# EasyEDA Pro project Arduino UNO DIY.eprj, board PCB3A
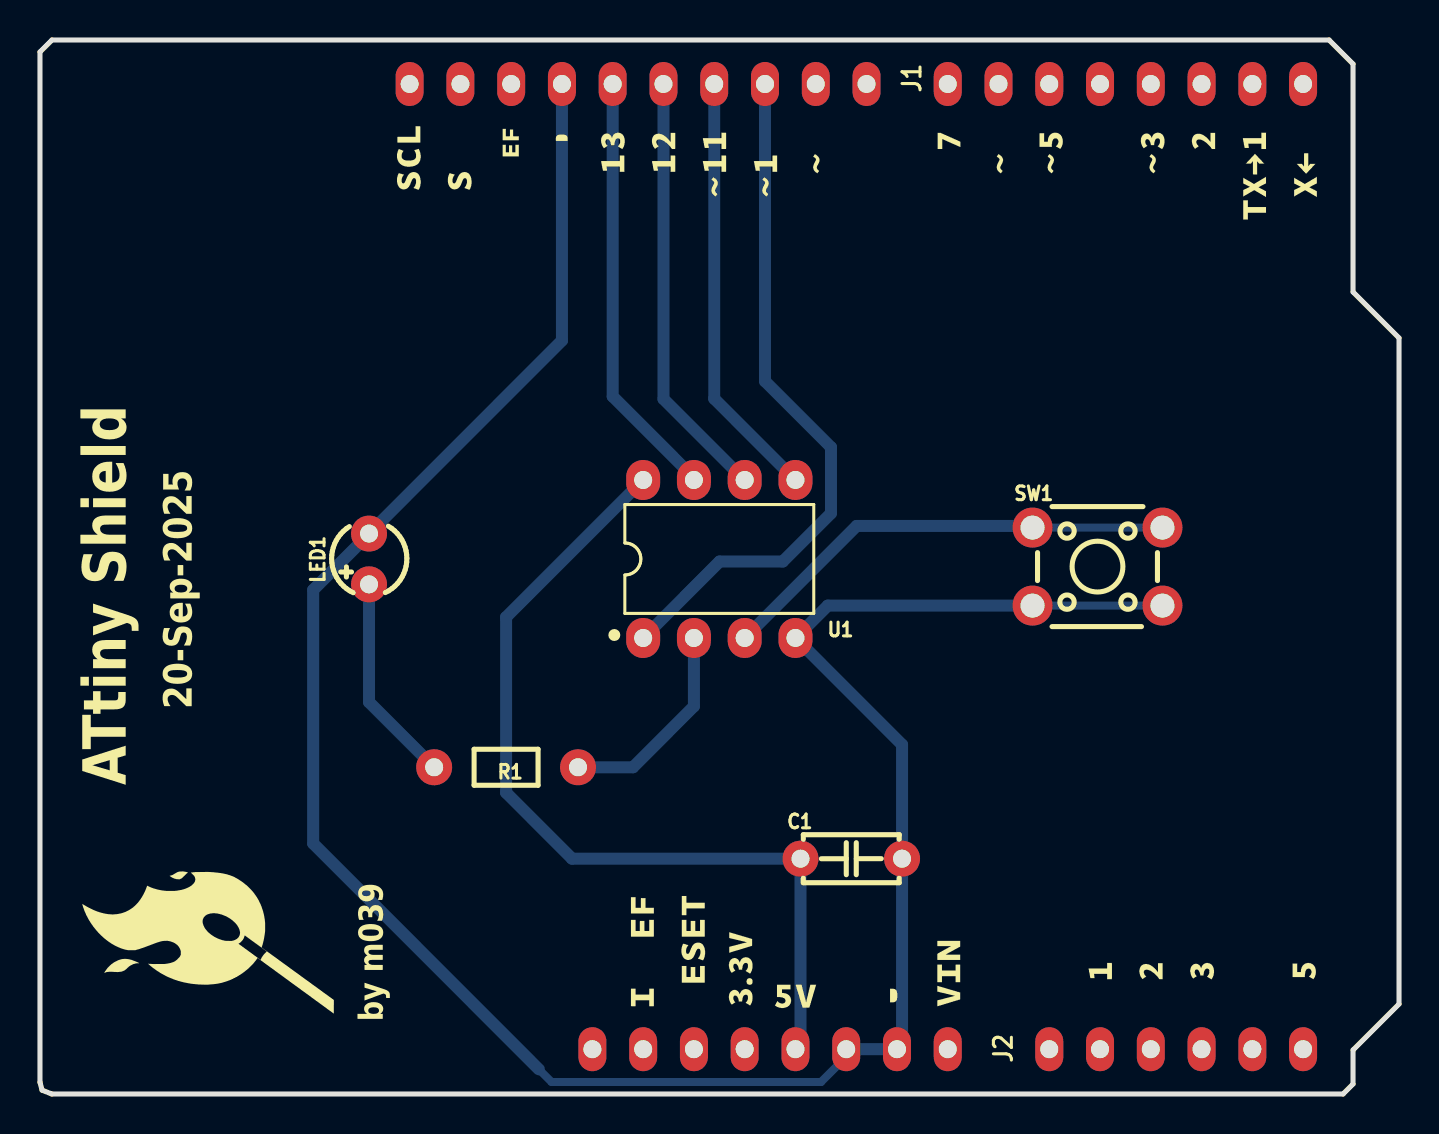
[diagram p12: board, top side]
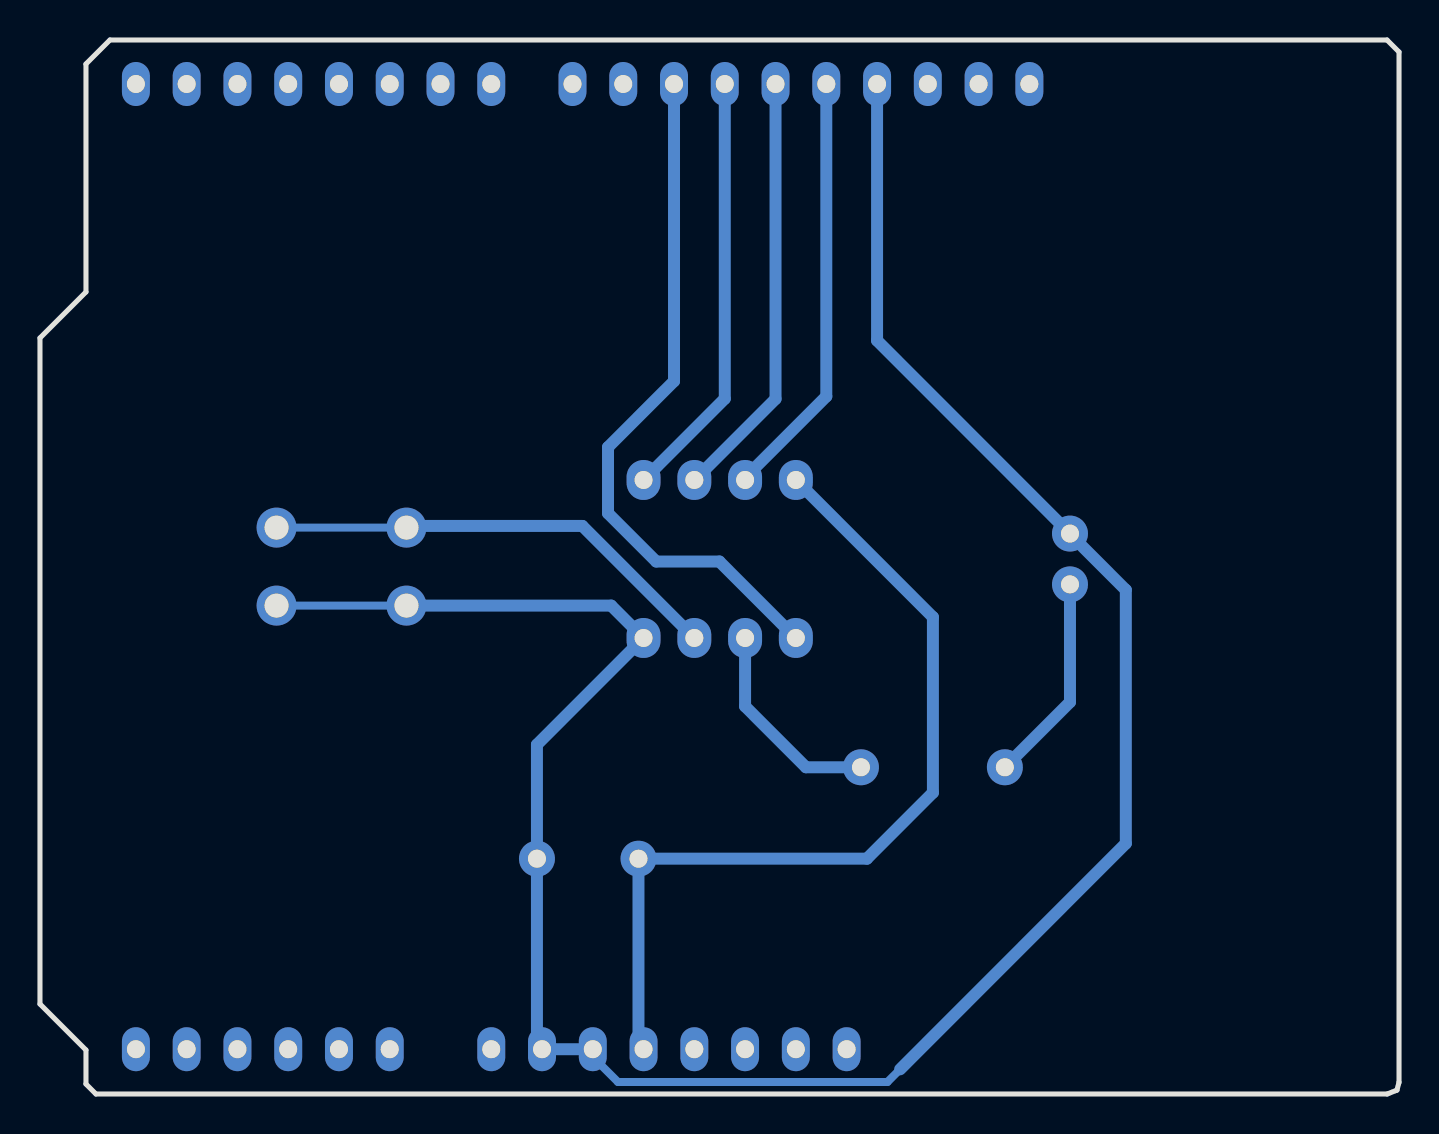
[diagram p13: board, bottom side, seen from below]

Outline 68 x 52.7 mm; copper layers: Top Layer, Bottom Layer. Coordinates in mm from the lower left corner of the outline.
Outline path: 0,52.1 0.6,52.7 64.5,52.7 65.7,51.5 65.7,40.1 68,37.8 68,4.5 65.7,2.2 65.7,0.5 65.2,0 0.59,0 0.1,0.19 0,0.59 0,52.1
Stack: Top Layer 0.035mm / Dielectric1 1.51mm FR4 er 4.5 / Bottom Layer 0.035mm

## Design rules (mm)
template: Custom Config
spacing copperThickness1oz (default): track to track 0.2, other pairs 0.152 to 0.4
spacing copperThickness2oz: track to track 0.203, other pairs 0.152 to 0.3
track width copperThickness1oz (default): min 0.127, default 0.6, max 2.54
track width copperThickness2oz: min 0.203, default 0.4, max 2.54
differential pair differentialPair (default): width min 0.127, default 0.254, max 2.54; gap min 0.152, default 0.152
via viaSize (default): diameter min 0.5, default 0.61, max 10; hole min 0.3, default 0.305, max 6.3

## Placement (name value [footprint] x y rotation side)
C1  100nF  [CAP-TH_L4.8-W2.4-P5.08-D0.6]  40.59 11.77 0 top
J1  -  [Arduino Uno Top Header]  41.36 50.5 0 top
J2  -  [Arduino Uno Bottom Header]  45.55 2.11 0 top
LED1  -  [LED-TH_BD3.0-P2.54-FD]  16.46 26.75 90 top
R1  200Ω  [RES-TH_BD1.8-L3.2-P7.20-D0.4]  23.32 16.34 180 top
SW1  -  [KEY-TH_4P-L6.0-W6.0-P3.90-LS6.5]  52.91 26.37 0 top
U1  ATTINY85-20PU  [PDIP-8_L9.3-W6.4-P2.54-LS7.9-BL-1]  33.99 26.75 0 top

## Footprints (pads in the part's own frame, mm; a bottom-side part is the same pattern mirrored in y, then rotated)
Arduino Uno Bottom Header
  oval 1.4x2.2 hole 0.9: 1(-17.907,0.127) 2(-15.367,0.127) 3(-12.827,0.127) 4(-10.287,0.127) 5(-7.747,0.127) 6(-5.207,0.127) 7(-2.667,0.127) 8(-0.127,0.127) 9(4.953,0.127) 10(7.493,0.127) 11(10.033,0.127) 12(12.573,0.127) 13(15.113,0.127) 14(17.653,0.127)
Arduino Uno Top Header
  oval 1.4x2.2 hole 0.9: 1(21.844,0) 2(19.304,0) 3(16.764,0) 4(14.224,0) 5(11.684,0) 6(9.144,0) 7(6.604,0) 8(4.064,0) 9(0,0) 10(-2.54,0) 11(-5.08,0) 12(-7.62,0) 13(-10.16,0) 14(-12.7,0) 15(-15.24,0) 16(-17.78,0) 17(-20.32,0) 18(-22.86,0)
CAP-TH_L4.8-W2.4-P5.08-D0.6
  round 1.8 hole 0.9: 1(-2.54,0) 2(2.54,0)
KEY-TH_4P-L6.0-W6.0-P3.90-LS6.5
  round 2 hole 1.2x0.9: 1(-3.25,1.95) 2(3.25,1.95) 3(-3.25,-1.95) 4(3.25,-1.95)
LED-TH_BD3.0-P2.54-FD
  round 1.8 hole 0.9: 1(-1.27,0) 2(1.27,0)
PDIP-8_L9.3-W6.4-P2.54-LS7.9-BL-1
  oval 1.7x2 hole 0.9: 1(-3.81,-3.95) 2(-1.27,-3.95) 3(1.27,-3.95) 4(3.81,-3.95) 5(3.81,3.95) 6(1.27,3.95) 7(-1.27,3.95) 8(-3.81,3.95)
RES-TH_BD1.8-L3.2-P7.20-D0.4
  round 1.8 hole 0.9: 1(-3.6,0) 2(3.6,0)

## Nets
As in the schematic.

Pads without a net: J1 1 2 3 4 5 6 7 8 9 10 16 17 18; J2 1 2 3 4 8 9 10 11 12 13 14

## Routing (per net, layer and track width the routed paths; a pad name or vN(x,y) marks a point on that pad's centre or on a via; arc(x,y) is an arc through that point)
GND: length 120.1
  Bottom Layer w0.4: SW1.4 SW1.3 ; 24.96,1.24 25.6,0.6 39.08,0.6 40.34,1.86 J2.6
  Bottom Layer w0.6: 24.96,1.24 13.67,12.53 13.67,25.2 16.46,28 LED1.2 26.12,37.67 J1.15 ; SW1.3 39.42,24.42 U1.4 43.13,17.47 C1.2 43.13,2.49 J2.7 J2.6
VCC: length 44.2
  Bottom Layer w0.6: U1.8 23.32,23.84 23.32,15.07 26.62,11.77 C1.1 38.05,2.49 J2.5
BUTTON: length 23.3
  Bottom Layer w0.4: SW1.2 SW1.1
  Bottom Layer w0.6: U1.3 40.86,28.4 49.58,28.4 SW1.1
LED: length 10.5
  Bottom Layer w0.6: U1.2 32.72,19.39 29.67,16.34 R1.1
MISO: length 21.5
  Bottom Layer w0.6: U1.6 35.25,30.7 31.2,34.75 J1.13
MOSI: length 21.5
  Bottom Layer w0.6: U1.5 33.74,34.77 J1.12
RST: length 34.8
  Bottom Layer w0.6: J1.11 36.28,35.64 39.58,32.34 39.58,29.04 37.17,26.62 34,26.62 U1.1
SCK: length 21.5
  Bottom Layer w0.6: J1.14 28.66,34.88 32.72,30.82 U1.7
$1N517: length 11
  Bottom Layer w0.6: 16.46,25.99 16.46,19.6 R1.2

## Text on the board
Top Silkscreen Layer: by m039 | 20-Sep-2025 | ATtiny Shield
